# Altium schematic sheet Intel16_UNI3_Q3.SchDoc
size A3; SheetNumber: 9; SheetTotal: 15
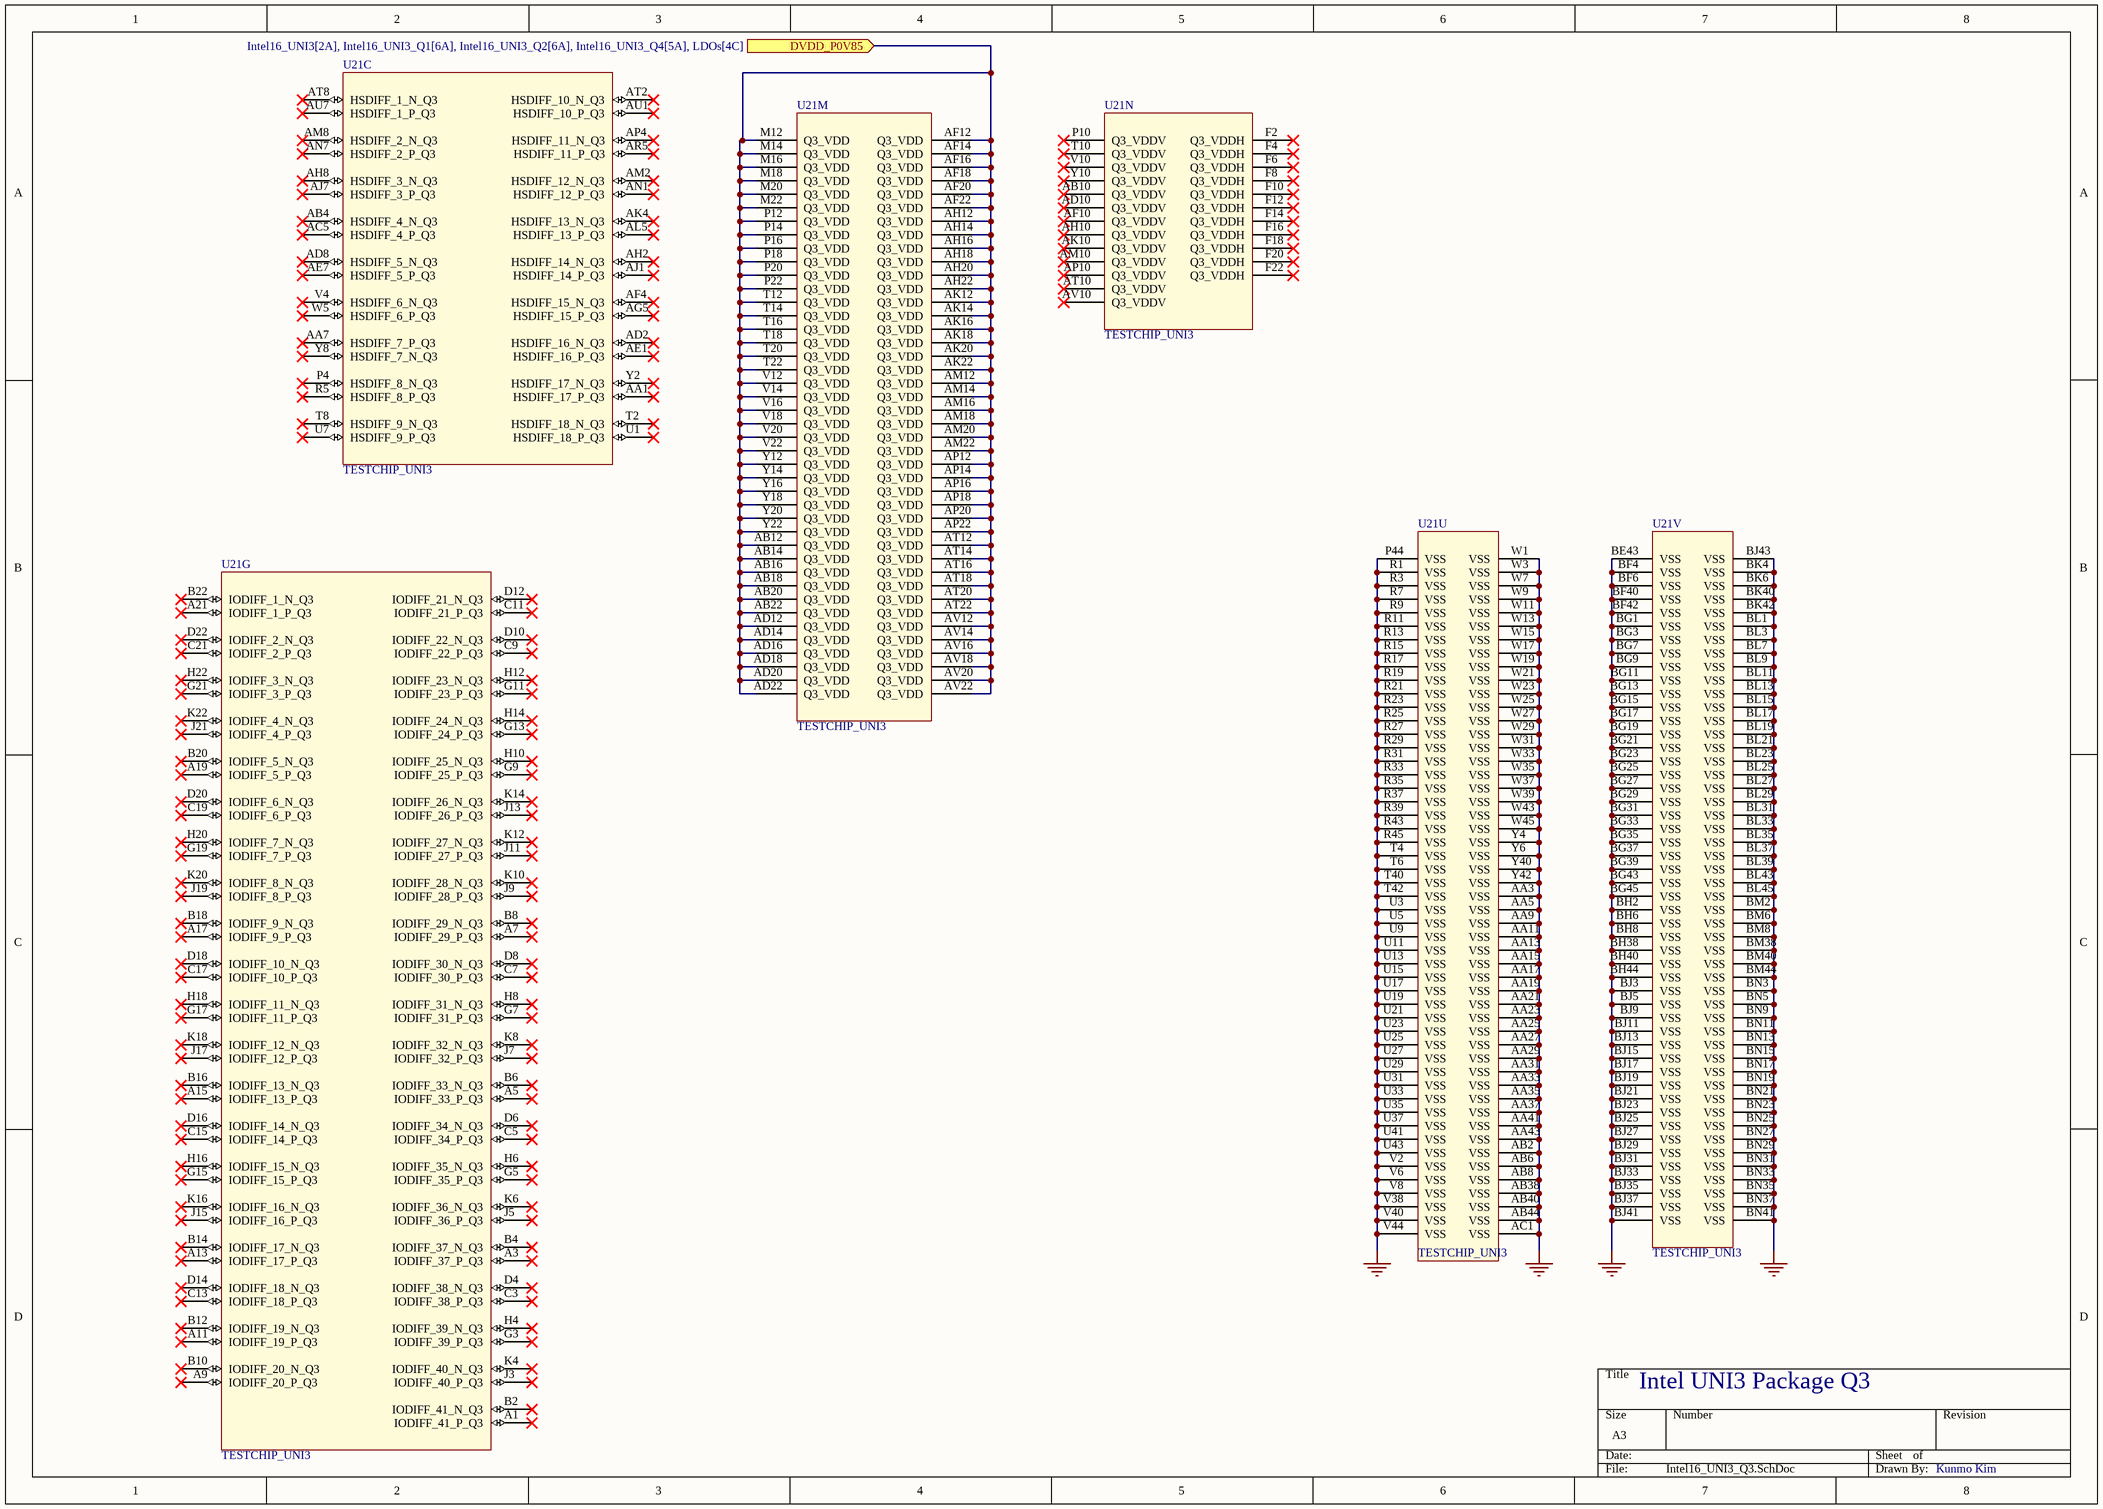
[diagram p0: Intel16_UNI3_Q3.SchDoc]

## Parts
U21  TESTCHIP_UNI3  [BGA-1733-.92-37.5X37.5]  (parts C,G,M,N,U,V of 25)

## Ports
DVDD_P0V85 (in, see Intel16_UNI3[2A], Intel16_UNI3_Q1[6A], Intel16_UNI3_Q2[6A], Intel16_UNI3_Q4[5A], LDOs[4C])

## Nets
GND: U21.AA3(VSS) U21.AA5(VSS) U21.AA9(VSS) U21.AA11(VSS) U21.AA13(VSS) U21.AA15(VSS) U21.AA17(VSS) U21.AA19(VSS) U21.AA21(VSS) U21.AA23(VSS) U21.AA25(VSS) U21.AA27(VSS) U21.AA29(VSS) U21.AA31(VSS) U21.AA33(VSS) U21.AA35(VSS) U21.AA37(VSS) U21.AA41(VSS) U21.AA43(VSS) U21.AB2(VSS) U21.AB6(VSS) U21.AB8(VSS) U21.AB38(VSS) U21.AB40(VSS) U21.AB44(VSS) U21.AC1(VSS) U21.BE43(VSS) U21.BF4(VSS) U21.BF6(VSS) U21.BF40(VSS) U21.BF42(VSS) U21.BG1(VSS) U21.BG3(VSS) U21.BG7(VSS) U21.BG9(VSS) U21.BG11(VSS) U21.BG13(VSS) U21.BG15(VSS) U21.BG17(VSS) U21.BG19(VSS) U21.BG21(VSS) U21.BG23(VSS) U21.BG25(VSS) U21.BG27(VSS) U21.BG29(VSS) U21.BG31(VSS) U21.BG33(VSS) U21.BG35(VSS) U21.BG37(VSS) U21.BG39(VSS) U21.BG43(VSS) U21.BG45(VSS) U21.BH2(VSS) U21.BH6(VSS) U21.BH8(VSS) U21.BH38(VSS) U21.BH40(VSS) U21.BH44(VSS) U21.BJ3(VSS) U21.BJ5(VSS) U21.BJ9(VSS) U21.BJ11(VSS) U21.BJ13(VSS) U21.BJ15(VSS) U21.BJ17(VSS) U21.BJ19(VSS) U21.BJ21(VSS) U21.BJ23(VSS) U21.BJ25(VSS) U21.BJ27(VSS) U21.BJ29(VSS) U21.BJ31(VSS) U21.BJ33(VSS) U21.BJ35(VSS) U21.BJ37(VSS) U21.BJ41(VSS) U21.BJ43(VSS) U21.BK4(VSS) U21.BK6(VSS) U21.BK40(VSS) U21.BK42(VSS) U21.BL1(VSS) U21.BL3(VSS) U21.BL7(VSS) U21.BL9(VSS) U21.BL11(VSS) U21.BL13(VSS) U21.BL15(VSS) U21.BL17(VSS) U21.BL19(VSS) U21.BL21(VSS) U21.BL23(VSS) U21.BL25(VSS) U21.BL27(VSS) U21.BL29(VSS) U21.BL31(VSS) U21.BL33(VSS) U21.BL35(VSS) U21.BL37(VSS) U21.BL39(VSS) U21.BL43(VSS) U21.BL45(VSS) U21.BM2(VSS) U21.BM6(VSS) U21.BM8(VSS) U21.BM38(VSS) U21.BM40(VSS) U21.BM44(VSS) U21.BN3(VSS) U21.BN5(VSS) U21.BN9(VSS) U21.BN11(VSS) U21.BN13(VSS) U21.BN15(VSS) U21.BN17(VSS) U21.BN19(VSS) U21.BN21(VSS) U21.BN23(VSS) U21.BN25(VSS) U21.BN27(VSS) U21.BN29(VSS) U21.BN31(VSS) U21.BN33(VSS) U21.BN35(VSS) U21.BN37(VSS) U21.BN41(VSS) U21.P44(VSS) U21.R1(VSS) U21.R3(VSS) U21.R7(VSS) U21.R9(VSS) U21.R11(VSS) U21.R13(VSS) U21.R15(VSS) U21.R17(VSS) U21.R19(VSS) U21.R21(VSS) U21.R23(VSS) U21.R25(VSS) U21.R27(VSS) U21.R29(VSS) U21.R31(VSS) U21.R33(VSS) U21.R35(VSS) U21.R37(VSS) U21.R39(VSS) U21.R43(VSS) U21.R45(VSS) U21.T4(VSS) U21.T6(VSS) U21.T40(VSS) U21.T42(VSS) U21.U3(VSS) U21.U5(VSS) U21.U9(VSS) U21.U11(VSS) U21.U13(VSS) U21.U15(VSS) U21.U17(VSS) U21.U19(VSS) U21.U21(VSS) U21.U23(VSS) U21.U25(VSS) U21.U27(VSS) U21.U29(VSS) U21.U31(VSS) U21.U33(VSS) U21.U35(VSS) U21.U37(VSS) U21.U41(VSS) U21.U43(VSS) U21.V2(VSS) U21.V6(VSS) U21.V8(VSS) U21.V38(VSS) U21.V40(VSS) U21.V44(VSS) U21.W1(VSS) U21.W3(VSS) U21.W7(VSS) U21.W9(VSS) U21.W11(VSS) U21.W13(VSS) U21.W15(VSS) U21.W17(VSS) U21.W19(VSS) U21.W21(VSS) U21.W23(VSS) U21.W25(VSS) U21.W27(VSS) U21.W29(VSS) U21.W31(VSS) U21.W33(VSS) U21.W35(VSS) U21.W37(VSS) U21.W39(VSS) U21.W43(VSS) U21.W45(VSS) U21.Y4(VSS) U21.Y6(VSS) U21.Y40(VSS) U21.Y42(VSS)
DVDD_P0V85: U21.AB12(Q3_VDD) U21.AB14(Q3_VDD) U21.AB16(Q3_VDD) U21.AB18(Q3_VDD) U21.AB20(Q3_VDD) U21.AB22(Q3_VDD) U21.AD12(Q3_VDD) U21.AD14(Q3_VDD) U21.AD16(Q3_VDD) U21.AD18(Q3_VDD) U21.AD20(Q3_VDD) U21.AD22(Q3_VDD) U21.AF12(Q3_VDD) U21.AF14(Q3_VDD) U21.AF16(Q3_VDD) U21.AF18(Q3_VDD) U21.AF20(Q3_VDD) U21.AF22(Q3_VDD) U21.AH12(Q3_VDD) U21.AH14(Q3_VDD) U21.AH16(Q3_VDD) U21.AH18(Q3_VDD) U21.AH20(Q3_VDD) U21.AH22(Q3_VDD) U21.AK12(Q3_VDD) U21.AK14(Q3_VDD) U21.AK16(Q3_VDD) U21.AK18(Q3_VDD) U21.AK20(Q3_VDD) U21.AK22(Q3_VDD) U21.AM12(Q3_VDD) U21.AM14(Q3_VDD) U21.AM16(Q3_VDD) U21.AM18(Q3_VDD) U21.AM20(Q3_VDD) U21.AM22(Q3_VDD) U21.AP12(Q3_VDD) U21.AP14(Q3_VDD) U21.AP16(Q3_VDD) U21.AP18(Q3_VDD) U21.AP20(Q3_VDD) U21.AP22(Q3_VDD) U21.AT12(Q3_VDD) U21.AT14(Q3_VDD) U21.AT16(Q3_VDD) U21.AT18(Q3_VDD) U21.AT20(Q3_VDD) U21.AT22(Q3_VDD) U21.AV12(Q3_VDD) U21.AV14(Q3_VDD) U21.AV16(Q3_VDD) U21.AV18(Q3_VDD) U21.AV20(Q3_VDD) U21.AV22(Q3_VDD) U21.M12(Q3_VDD) U21.M14(Q3_VDD) U21.M16(Q3_VDD) U21.M18(Q3_VDD) U21.M20(Q3_VDD) U21.M22(Q3_VDD) U21.P12(Q3_VDD) U21.P14(Q3_VDD) U21.P16(Q3_VDD) U21.P18(Q3_VDD) U21.P20(Q3_VDD) U21.P22(Q3_VDD) U21.T12(Q3_VDD) U21.T14(Q3_VDD) U21.T16(Q3_VDD) U21.T18(Q3_VDD) U21.T20(Q3_VDD) U21.T22(Q3_VDD) U21.V12(Q3_VDD) U21.V14(Q3_VDD) U21.V16(Q3_VDD) U21.V18(Q3_VDD) U21.V20(Q3_VDD) U21.V22(Q3_VDD) U21.Y12(Q3_VDD) U21.Y14(Q3_VDD) U21.Y16(Q3_VDD) U21.Y18(Q3_VDD) U21.Y20(Q3_VDD) U21.Y22(Q3_VDD) ; port DVDD_P0V85

Not connected (* = marked no-connect by the designer): U21 A1(IODIFF_41_P_Q3)* A3(IODIFF_37_P_Q3)* A5(IODIFF_33_P_Q3)* A7(IODIFF_29_P_Q3)* A9(IODIFF_20_P_Q3)* A11(IODIFF_19_P_Q3)* A13(IODIFF_17_P_Q3)* A15(IODIFF_13_P_Q3)* A17(IODIFF_9_P_Q3)* A19(IODIFF_5_P_Q3)* A21(IODIFF_1_P_Q3)* AA1(HSDIFF_17_P_Q3)* AA7(HSDIFF_7_P_Q3)* AB4(HSDIFF_4_N_Q3)* AB10(Q3_VDDV)* AC5(HSDIFF_4_P_Q3)* AD2(HSDIFF_16_N_Q3)* AD8(HSDIFF_5_N_Q3)* AD10(Q3_VDDV)* AE1(HSDIFF_16_P_Q3)* AE7(HSDIFF_5_P_Q3)* AF4(HSDIFF_15_N_Q3)* AF10(Q3_VDDV)* AG5(HSDIFF_15_P_Q3)* AH2(HSDIFF_14_N_Q3)* AH8(HSDIFF_3_N_Q3)* AH10(Q3_VDDV)* AJ1(HSDIFF_14_P_Q3)* AJ7(HSDIFF_3_P_Q3)* AK4(HSDIFF_13_N_Q3)* AK10(Q3_VDDV)* AL5(HSDIFF_13_P_Q3)* AM2(HSDIFF_12_N_Q3)* AM8(HSDIFF_2_N_Q3)* AM10(Q3_VDDV)* AN1(HSDIFF_12_P_Q3)* AN7(HSDIFF_2_P_Q3)* AP4(HSDIFF_11_N_Q3)* AP10(Q3_VDDV)* AR5(HSDIFF_11_P_Q3)* AT2(HSDIFF_10_N_Q3)* AT8(HSDIFF_1_N_Q3)* AT10(Q3_VDDV)* AU1(HSDIFF_10_P_Q3)* AU7(HSDIFF_1_P_Q3)* AV10(Q3_VDDV)* B2(IODIFF_41_N_Q3)* B4(IODIFF_37_N_Q3)* B6(IODIFF_33_N_Q3)* B8(IODIFF_29_N_Q3)* B10(IODIFF_20_N_Q3)* B12(IODIFF_19_N_Q3)* B14(IODIFF_17_N_Q3)* B16(IODIFF_13_N_Q3)* B18(IODIFF_9_N_Q3)* B20(IODIFF_5_N_Q3)* B22(IODIFF_1_N_Q3)* C3(IODIFF_38_P_Q3)* C5(IODIFF_34_P_Q3)* C7(IODIFF_30_P_Q3)* C9(IODIFF_22_P_Q3)* C11(IODIFF_21_P_Q3)* C13(IODIFF_18_P_Q3)* C15(IODIFF_14_P_Q3)* C17(IODIFF_10_P_Q3)* C19(IODIFF_6_P_Q3)* C21(IODIFF_2_P_Q3)* D4(IODIFF_38_N_Q3)* D6(IODIFF_34_N_Q3)* D8(IODIFF_30_N_Q3)* D10(IODIFF_22_N_Q3)* D12(IODIFF_21_N_Q3)* D14(IODIFF_18_N_Q3)* D16(IODIFF_14_N_Q3)* D18(IODIFF_10_N_Q3)* D20(IODIFF_6_N_Q3)* D22(IODIFF_2_N_Q3)* F2(Q3_VDDH)* F4(Q3_VDDH)* F6(Q3_VDDH)* F8(Q3_VDDH)* F10(Q3_VDDH)* F12(Q3_VDDH)* F14(Q3_VDDH)* F16(Q3_VDDH)* F18(Q3_VDDH)* F20(Q3_VDDH)* F22(Q3_VDDH)* G3(IODIFF_39_P_Q3)* G5(IODIFF_35_P_Q3)* G7(IODIFF_31_P_Q3)* G9(IODIFF_25_P_Q3)* G11(IODIFF_23_P_Q3)* G13(IODIFF_24_P_Q3)* G15(IODIFF_15_P_Q3)* G17(IODIFF_11_P_Q3)* G19(IODIFF_7_P_Q3)* G21(IODIFF_3_P_Q3)* H4(IODIFF_39_N_Q3)* H6(IODIFF_35_N_Q3)* H8(IODIFF_31_N_Q3)* H10(IODIFF_25_N_Q3)* H12(IODIFF_23_N_Q3)* H14(IODIFF_24_N_Q3)* H16(IODIFF_15_N_Q3)* H18(IODIFF_11_N_Q3)* H20(IODIFF_7_N_Q3)* H22(IODIFF_3_N_Q3)* J3(IODIFF_40_P_Q3)* J5(IODIFF_36_P_Q3)* J7(IODIFF_32_P_Q3)* J9(IODIFF_28_P_Q3)* J11(IODIFF_27_P_Q3)* J13(IODIFF_26_P_Q3)* J15(IODIFF_16_P_Q3)* J17(IODIFF_12_P_Q3)* J19(IODIFF_8_P_Q3)* J21(IODIFF_4_P_Q3)* K4(IODIFF_40_N_Q3)* K6(IODIFF_36_N_Q3)* K8(IODIFF_32_N_Q3)* K10(IODIFF_28_N_Q3)* K12(IODIFF_27_N_Q3)* K14(IODIFF_26_N_Q3)* K16(IODIFF_16_N_Q3)* K18(IODIFF_12_N_Q3)* K20(IODIFF_8_N_Q3)* K22(IODIFF_4_N_Q3)* P4(HSDIFF_8_N_Q3)* P10(Q3_VDDV)* R5(HSDIFF_8_P_Q3)* T2(HSDIFF_18_N_Q3)* T8(HSDIFF_9_N_Q3)* T10(Q3_VDDV)* U1(HSDIFF_18_P_Q3)* U7(HSDIFF_9_P_Q3)* V4(HSDIFF_6_N_Q3)* V10(Q3_VDDV)* W5(HSDIFF_6_P_Q3)* Y2(HSDIFF_17_N_Q3)* Y8(HSDIFF_7_N_Q3)* Y10(Q3_VDDV)*

## Notes on the sheet
- Intel UNI3 Package Q3
- Kunmo Kim

## Library data of the parts
U21 = TESTCHIP_UNI2: UNI2 interposer